# EasyEDA Pro project Iot-Whgm5开发板.eprj, board PCB1 (continued)
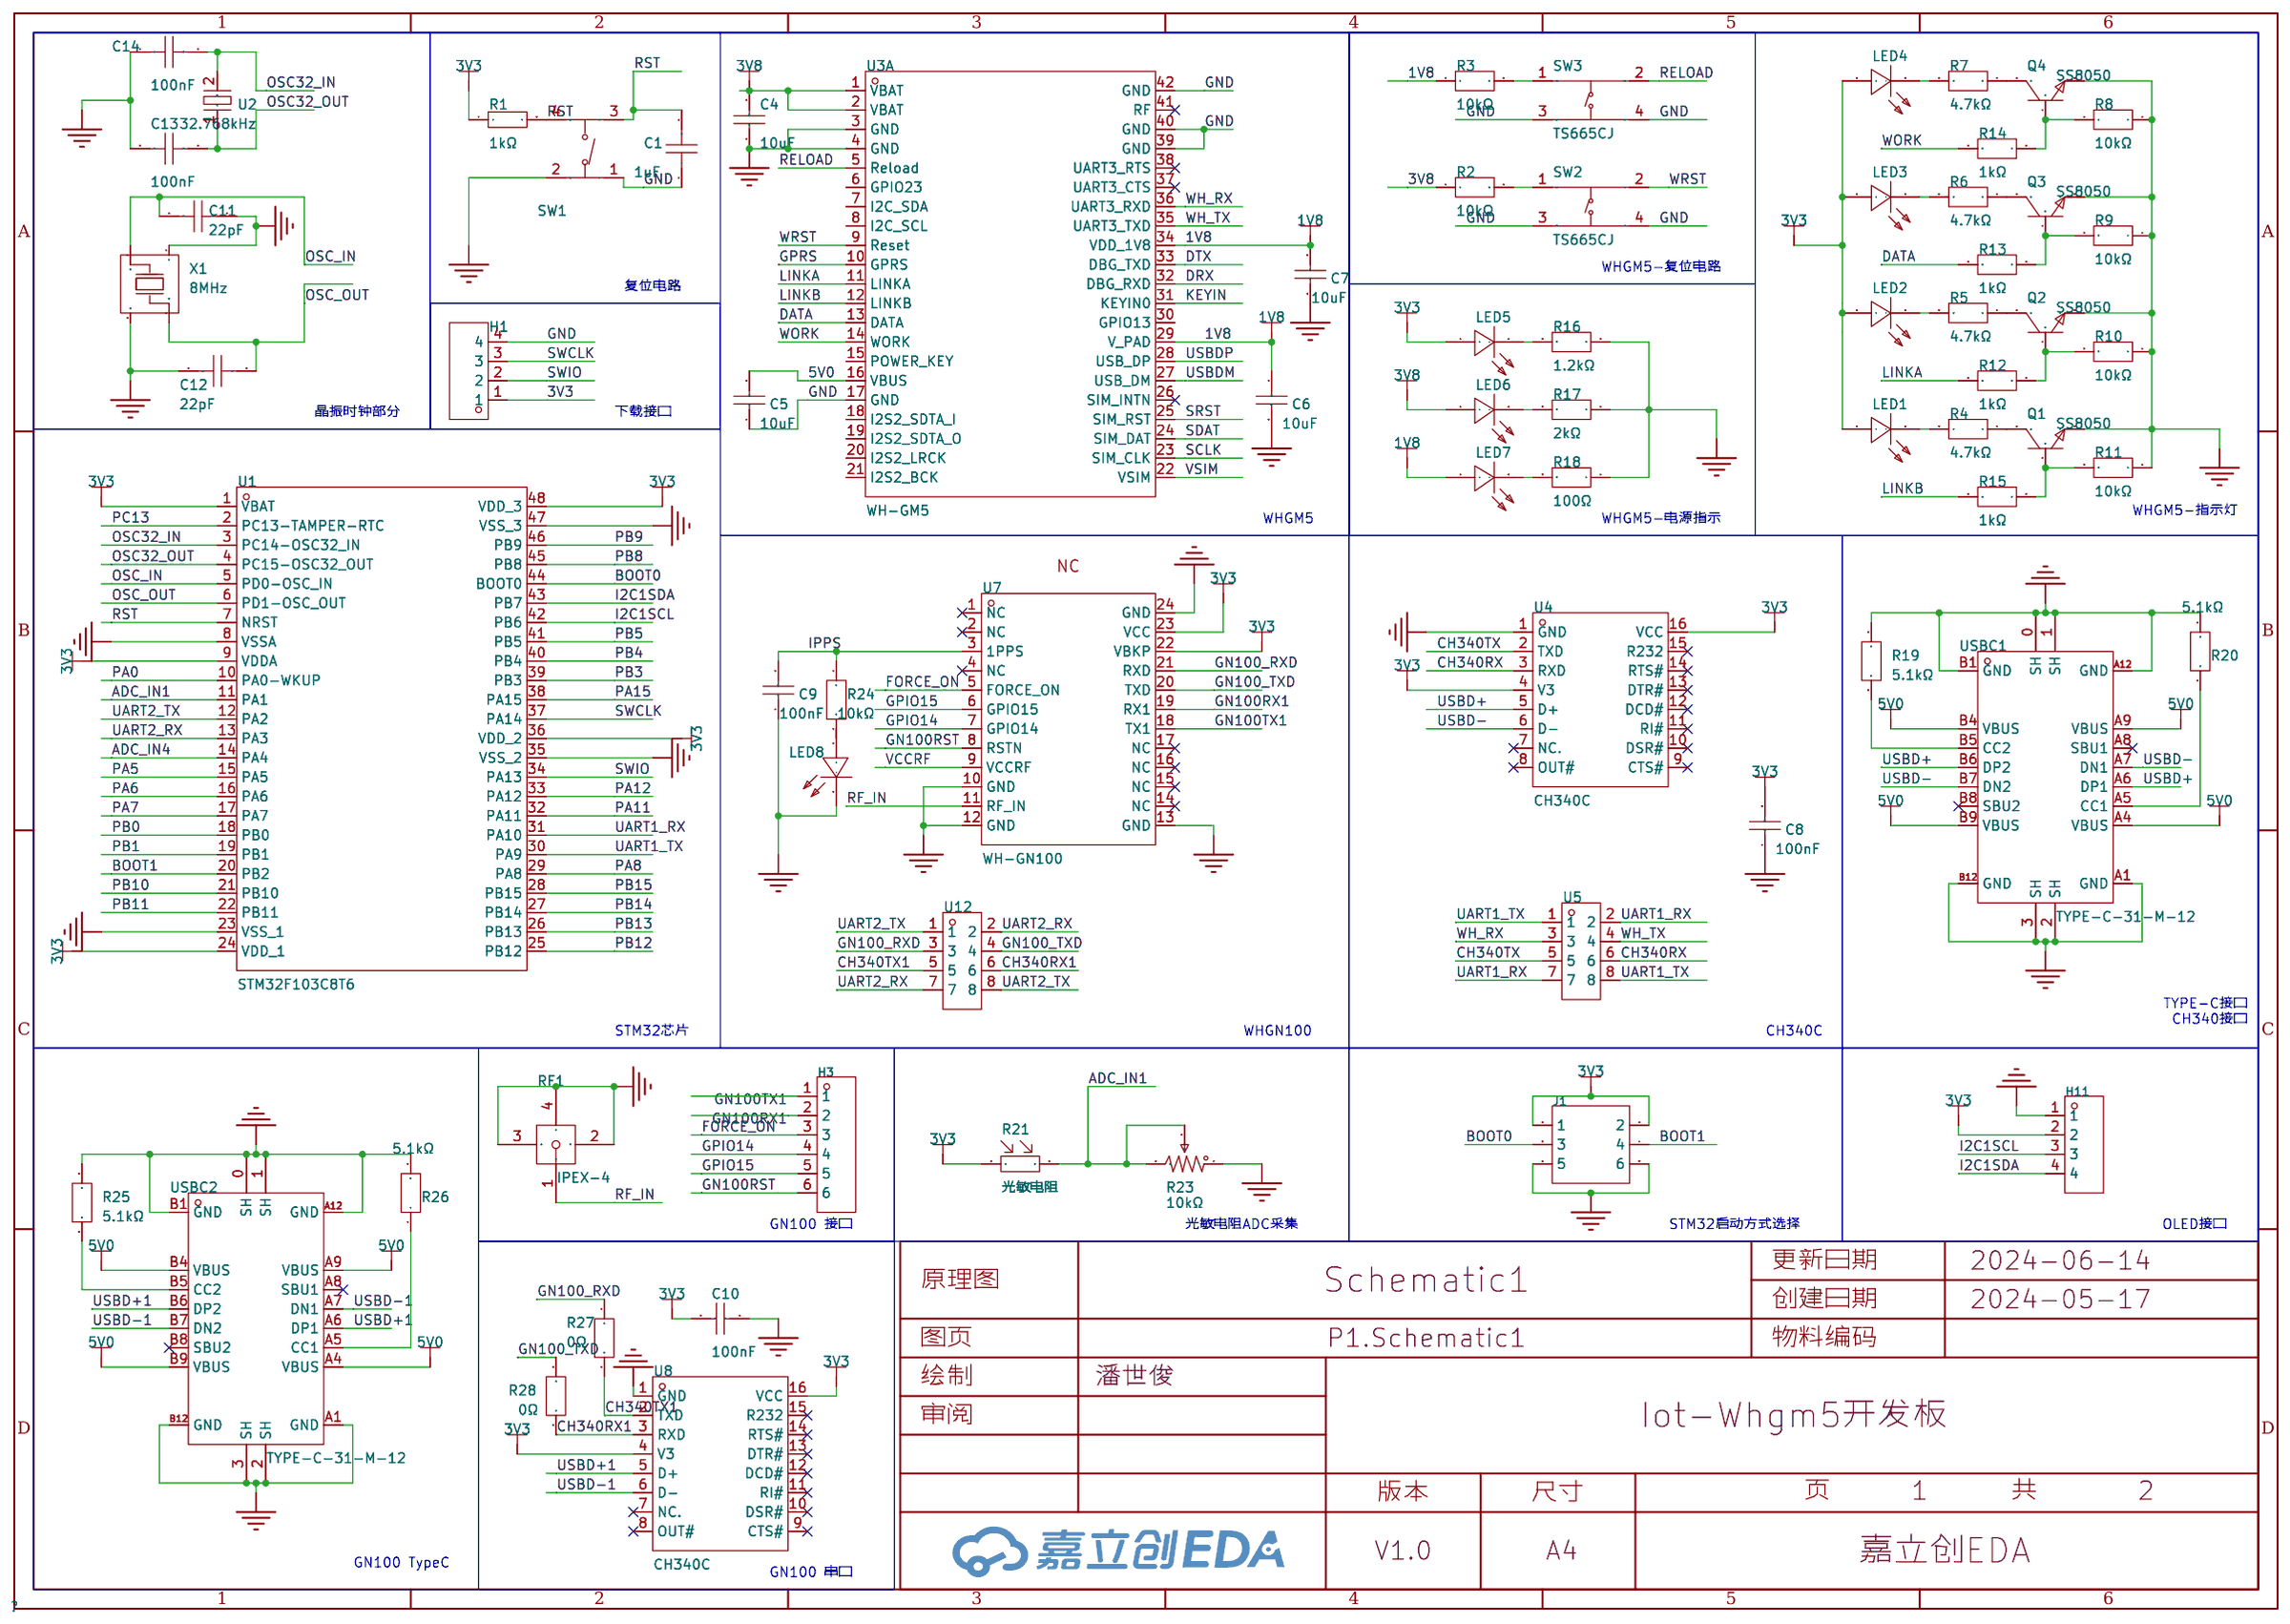
[diagram p0: P1]
## Routing (per net, layer and track width the routed paths; a pad name or vN(x,y) marks a point on that pad's centre or on a via; arc(x,y) is an arc through that point)
1V8: length 50.3
  Top Layer w0.254: U3.29 46.01,46.24 C7.1 47.2,38.87 40.13,31.8 31.24,31.8 C20.1 ; U3.34 49.87,52.59 LED7.1 ; v1(49.92,52.56) 49.92,55.58 R3.1
  Bottom Layer w0.254: v1(49.92,52.56) 49.92,51.46 C6.1 47.2,48.75 v1(47.2,47.37)
3V3: length 17.5
  Top Layer w0.178: 48.82,26.18 49.41,25.58 v1(50.8,25.58)
  Top Layer w0.254: 51.64,29 51.64,29.3 v1(51.95,29.6) ; 61.27,28.31 61.27,28.3 v1(60.38,27.41) ; 57.65,22.99 57.97,22.67 v1(58.55,22.67) ; v1(52.32,18.97) 52.19,19.1 51.64,19.1 ; v1(53.59,29.64) 53.77,29.47 53.77,29
  Top Layer w0.508: 5.4,49.66 5.4,47.35 5.42,47.33 5.42,45.12 5.88,44.66 v1(5.88,41.49) ; 5.39,52.03 5.39,49.56
  vias: v1(2.05,29.84) v1(4.7,31.95) v1(8.52,25.07) v1(27.77,4.58) v1(29.29,10.04) v1(30.63,4.63) v1(35.18,21.77) v1(36.83,19.99) v1(46.92,16.05) v1(51.93,14.27) v1(57.81,33.97) v1(64.39,22.91) v1(70.87,49.83) v1(70.87,48.77) v1(71.25,26.72) v1(73.41,50.34) v1(73.53,45.03) v2(45.59,8.18) v2(48.13,5.64) v2(50.67,3.35) v2(55.43,2.39)
3V8: length 48.4
  Top Layer w0.254: U3.2 18.88,61.48 17.78,60.38 17.78,59.74 v1(14.48,56.44) ; C4.2 17.53,27.98 v1(17.53,45.39)
  Top Layer w0.508: U3.2 U3.1 17.9,64.23 R2.1 15.24,65.83 15.24,68.12 16.03,68.91 LED6.1
  Bottom Layer w0.254: v1(17.53,45.39) 17.53,50.85 14.48,53.9 v1(14.48,56.44)
5V0: length 167.8
  Top Layer w0.254: USBC3.B9 6.78,62.5 6.56,62.28 5.59,62.28 4.44,63.42 3.68,63.42 3.56,63.3 3.56,57.33 3.81,57.07 4.34,57.07 5.46,58.19 6.63,58.19 7.12,57.7 USBC3.A9 7.69,57.84 v1(8.76,57.84) ; v1(21.97,44.23) 21.97,21.43 AMS1117-ADJ.3 ; USBC2.A9 USBC2.B4 72.23,7.08 72.08,6.94 72.08,6.93 72.01,6.86 72.01,5.64 72.52,5.13 72.52,2.08 72.26,1.83 67.56,1.83 67.31,2.08 67.31,5 67.94,5.64 67.94,6.86 67.73,7.08 USBC2.B9 67.73,8.5 67.29,8.94 65.41,8.94 60.45,3.99 47.24,3.99 32.24,18.99 AMS1117-1V8.3
  Top Layer w0.381: U3.16 21.44,43.7 v1(21.97,44.23) ; USBC1.B9 7.72,17.07 9.02,17.07 v1(9.4,17.45) ; DC1.1 13.08,14.1 v1(11.54,15.64) ; v1(8.76,12.37) 7.82,12.37 USBC1.A9
  Top Layer w0.508: AMS1117-3V3.3 22.49,2.32 19.81,5 19.81,14.38 C16.1
  Bottom Layer w0.254: v1(8.76,57.84) 15.75,57.84 21.97,51.61 v1(21.97,44.23)
  Bottom Layer w0.381: v1(9.4,17.45) 11.21,15.64 v1(11.54,15.64) 11.56,15.62 11.56,13.64 10.78,12.87 9.26,12.87 v1(8.76,12.37)
GND: length 2.6
  Top Layer w0.178: STM32F103C8T6.8 48.72,27.1 v2(48.13,27.1)
  Top Layer w0.254: v1(58.17,21.89) 58.05,21.89 57.3,22.64
  vias: v2(6.1,27.48) v2(6.98,33.83) v2(15.88,62.66) v2(16.76,35.1) v2(19.38,42.43) v2(24,20.75) v2(24,11.48) v2(31.37,43.48) v2(31.37,33.07) v2(32.13,49.71) v2(37.72,49.58) v2(37.97,43.61) v2(38.35,11.35) v2(39.24,39.55) v2(40.64,6.91) v2(45.09,21.39) v2(45.85,40.69) v2(46.99,25.07) v2(48.26,16.69) v2(48.39,8.94) v2(50.71,5.71) v2(51.69,23.42) v2(52.45,26.09) v2(53.25,3.25) v2(53.47,17.45) v2(57.53,2.52) v2(58.04,17.45) v2(59.69,19.86) v2(59.94,23.55) v2(60.2,21.13) v2(60.71,7.92) v2(61.59,32.05) v2(62.48,3.35) v2(63.75,12.88) v2(64.01,17.07) v2(67.77,20.76) v2(69.98,3.86) v2(70.23,14.91) v2(73.66,19.35) v2(73.79,21.51) v2(76.45,42.72) v2(78.61,22.53) v2(83.06,46.79)
VCCRF: length 9.6
  Top Layer w0.178: v1(62.74,38.28) 60.72,40.29 U7.9
  Bottom Layer w0.178: v1(62.48,34.34) 62.74,34.59 v1(62.74,38.28)
ADC_IN1: length 103.5
  Top Layer w0.178: H5.2 82.68,4.35 82.68,2.21 80.86,0.39 52.34,0.39 52.32,0.41 52.08,0.41 49.79,2.69 44.09,2.69 v1(35.18,11.61)
  Top Layer w0.254: v1(46.35,26.47) 46.79,26.03 47.54,26.03 49.01,24.56 v1(52.58,24.56)
  Top Layer w0.508: 贴片可调电阻 10M.3 66.41,31.8 贴片可调电阻 10M.2 63.08,30.72 光敏电阻.2
  Bottom Layer w0.178: v1(35.18,11.61) 35.18,13.88 41.56,20.26 41.56,22.67 44.22,25.33 44.22,26.24 44.7,26.72 46.1,26.72 v1(46.35,26.47)
  Bottom Layer w0.254: v1(52.58,24.56) 53.03,25.01 53.03,26.06 57.68,30.72 光敏电阻.2
ADC_IN4: length 52.6
  Top Layer w0.178: 热敏电阻.2 45.32,14.64 v1(44.32,13.64) ; H5.5 81.13,13.51 78.09,13.51 78.09,13.52 77.6,14.02 76.96,14.02 76.45,13.51 75.06,13.51 73.15,11.61 v1(70.36,11.61) ; v1(44.32,11.1) 49.02,6.4 51.82,6.4 54.98,9.56 v1(54.98,11.59)
  Top Layer w0.254: 48.11,22.64 44.91,19.44 10M可变电阻.2
  Bottom Layer w0.178: v1(70.36,11.61) 55.12,11.61 ; v1(44.32,11.1) v1(44.32,13.64)
BOOT0: length 19.4
  Top Layer w0.178: v1(52.71,27.1) 54.69,27.1 55.18,27.59
  Bottom Layer w0.178: J1.3 40,23.16 40,25.07 42.16,27.23 44.18,27.23 44.84,27.89 46.72,27.89 46.73,27.86 48.26,27.86 49.78,26.34 51.94,26.34 v1(52.71,27.1)
BOOT1: length 16.9
  Top Layer w0.178: v1(47.5,17.7) 50.23,20.44 50.23,20.52
  Top Layer w0.254: 38.22,24.95 39.87,24.95 40.51,24.31 40.77,24.31 v1(42.42,22.66)
  Bottom Layer w0.254: v1(42.42,22.66) 42.42,21.51 46.23,17.7 v1(47.5,17.7)
CH340RX: length 22.8
  Top Layer w0.254: CH340C.3 7.24,27.45 4.06,30.63 4.06,33.95 4.06,33.95 5.32,35.22 15.11,35.22 U5.6
  vias: v1(7.25,25.07)
CH340RX1:
  vias: v1(65.53,24.18)
CH340TX: length 22.7
  Top Layer w0.254: U5.5 12.74,36.36 12,35.62 4.46,35.62 3.17,34.34 3.17,28.37 3.56,27.99 3.68,27.99 4.32,28.63 4.57,28.63 4.88,28.31 4.88,27.17 5.59,26.47 5.59,26.01 5.97,25.63
  vias: v1(5.97,25.07)
CH340TX1:
  vias: v1(65.53,25.45)
DATA: length 5.1
  Top Layer w0.254: R13.2 14.7,47.51 U3.13
FORCE_ON: length 14
  Top Layer w0.254: U7.5 62.16,46.59 65.79,50.22 65.79,54.86 H3.3
GN100_RXD: length 47.9
  Top Layer w0.254: v1(72.64,48.82) 72.64,48.48 72.55,48.39 72.26,48.39 71.93,48.06 71.93,47.45 71.88,47.4 71.76,47.4 71.46,47.69 70.24,47.69 ; v1(73.49,13.02) 72.7,13.81 72.7,22.66 73.15,23.11 v1(73.15,23.55)
  Bottom Layer w0.254: v1(72.64,48.82) 72.64,48.48 72.73,48.39 73.27,48.39 74.29,47.37 74.29,46.91 73.75,46.37 72.94,46.37 72.85,46.28 72.85,24.28 73.15,23.98 v1(73.15,23.55) ; v1(73.49,13.02) 73.85,13.39 76.45,13.39 77.72,12.12 U12.3
GN100_TXD: length 46.3
  Top Layer w0.254: v1(71.5,13.02) 72.29,13.81 72.29,23.39 v1(72.14,23.55) ; 70.24,46.59 70.63,46.99 72.05,46.99 72.34,47.28 72.34,47.89 72.43,47.98 72.55,47.98 72.64,47.89 v1(72.64,47.55)
  Bottom Layer w0.254: v1(72.14,23.55) 72.14,23.98 72.44,24.28 72.44,46.45 72.77,46.77 73.58,46.77 73.88,47.07 73.88,47.2 73.1,47.98 72.73,47.98 72.64,47.89 v1(72.64,47.55) ; U12.4 72.41,12.12 v1(71.5,13.02)
GN100RST: length 17.4
  Top Layer w0.254: H3.6 59.88,53.25 v1(59.88,48.92) ; v1(61.98,45.9) 61.98,45.33 U7.8
  Bottom Layer w0.254: v1(59.88,48.92) 59.91,48.95 60.96,48.95 61.98,47.93 v1(61.98,45.9)
GN100RX1: length 22.9
  Top Layer w0.254: H3.2 69.35,54.91 69.44,55 69.44,56.64 67.65,58.43 67.53,58.43 67.44,58.34 67.44,57.69 67.69,57.44 67.94,57.44 68.2,57.18 68.2,56.17 67.94,55.91 67.69,55.91 67.44,55.66 67.44,51.83 67.69,51.58 67.86,51.58 68.11,51.32 68.11,50.31 67.86,50.05 67.69,50.05 67.44,49.8 67.44,48.53 67.7,48.27 67.7,47.01 67.44,46.75 67.44,46.24 68.53,45.15 68.66,45.15 69.01,45.49 70.24,45.49
GN100TX1: length 23
  Top Layer w0.254: H3.1 69.94,54.91 69.85,55 69.85,56.81 67.82,58.84 67.36,58.84 67.03,58.51 67.03,46.07 68.37,44.74 68.66,44.74 69.01,44.39 70.24,44.39
GPIO14: length 12.8
  Top Layer w0.254: v1(61.09,47.68) 63.3,49.89 H3.4
  Bottom Layer w0.254: v1(61.09,47.68) 61.09,45.9 59.69,44.5 v1(58.8,44.5)
GPIO15: length 10.6
  Top Layer w0.254: v1(59.82,47.68) 60.76,48.62 H3.5
  Bottom Layer w0.254: v1(58.67,45.52) 59.31,45.52 59.82,46.02 v1(59.82,47.68)
I2C1SCL: length 56.5
  Top Layer w0.254: v1(40.89,31.55) 40.89,29.01 45.94,23.96 v1(47.68,23.96) 52.96,23.96 58.14,29.13 59.69,29.13 59.94,29.39 68.83,29.39 72.64,33.2 H8.6 ; v1(39.75,32.82) 37.34,35.23 31.41,35.23 GND.3
  Bottom Layer w0.254: v1(40.89,31.55) 40.89,31.67 v1(39.75,32.82)
I2C1SDA: length 56.8
  Top Layer w0.254: v1(51.56,26.97) 51.56,25.83 51.94,25.45 53.72,25.45 55.51,27.24 55.53,27.24 57.94,29.64 59.56,29.64 59.82,29.9 68.71,29.9 73.79,34.98 75.18,34.98 H8.7 ; v1(38.48,32.44) 29.04,32.44 GND.4
  Bottom Layer w0.254: v1(51.56,26.97) 50.29,28.24 42.67,28.24 v1(38.48,32.44)
IPPS: length 1.8
  Bottom Layer w0.254: C9.2 56.9,50.12 v1(56.9,48.57)
LINKA: length 5.6
  Top Layer w0.254: U3.11 15.95,50.05 R12.2
LINKB: length 5.2
  Top Layer w0.254: R15.2 18.84,49.33 U3.12
OSC32_IN: length 9.4
  Top Layer w0.254: 50.94,28.3 50.04,29.2 50.04,31.67 52.28,33.91 52.67,33.91 100NF#2.2
OSC32_OUT: length 8.7
  Top Layer w0.254: 50.58,27.94 49.89,28.64 49.89,28.84 49.68,29.05 49.68,31.82 50.12,32.26 32K晶振.1 100NF.1
OSC_IN: length 8.3
  Top Layer w0.254: 22PF.2 47.58,34.02 8MHZ晶振.1 48.83,32.04 49.33,31.55 49.33,28.9 49.4,28.83 49.4,28.42 50.23,27.59
OSC_OUT: length 8.4
  Top Layer w0.254: 22PF#2.2 45.24,30.15 8MHZ晶振.3 46.28,29.39 48.35,29.39 49.02,28.72 49.02,28.09 49.88,27.24
PA0: length 75.1
  Top Layer w0.178: H5.1 79.01,0.69 52.2,0.69 49.91,2.97 45.34,2.97 35.18,13.13 v1(35.18,14.66)
  Top Layer w0.254: v1(47.24,26.97) 47.31,26.97 48.46,25.82
  Bottom Layer w0.178: v1(47.24,26.97) 46.61,27.61 44.96,27.61 43.94,26.59 43.94,25.47 41.28,22.8 41.28,20.75 v1(35.18,14.66)
PA5: length 48.3
  Top Layer w0.178: v1(46.1,19.74) 46.1,20.12 47.61,21.63 47.8,21.63 48.46,22.29
  Bottom Layer w0.178: v1(46.1,19.74) 46.1,19.1 46.35,18.85 47.88,18.85 50.34,16.38 50.34,14.1 53.77,10.67 79.32,10.67 80.01,11.35 80.01,14.38 H5.6
PA6: length 48.8
  Top Layer w0.178: v1(47.62,20.75) 47.64,20.75 48.82,21.93
  Bottom Layer w0.178: H5.7 81.41,17.58 79.73,15.9 79.73,11.58 79.12,10.97 53.97,10.97 50.67,14.27 50.67,16.56 48.01,19.23 46.99,19.23 46.86,19.35 46.86,19.99 v1(47.62,20.75)
PA7: length 43.5
  Top Layer w0.178: 49.17,21.58 48.39,20.8 48.39,20.55 47.75,19.91 v1(47.75,19.86)
  Bottom Layer w0.178: v1(47.75,19.86) 47.88,19.86 52.58,15.16 64.01,15.16 65.34,13.83 68.77,13.83 68.83,13.89 68.83,13.89 69.22,14.27 70.46,14.27 70.52,14.21 ; 70.52,14.21 74.36,14.21 74.55,14.4 74.55,17.96 74.93,18.34 76.33,18.34 78.85,20.86 H5.8 ; 70.52,14.21 70.53,14.22
PA8: length 85
  Top Layer w0.178: v1(67.69,10.08) 68.33,10.72 68.33,12.88 66.17,15.04 65.02,15.04 64.26,15.8 61.21,15.8 v1(60.58,16.43) ; v1(82.55,7.04) 84.07,8.56 v1(84.07,9.45) ; 55.18,20.52 54.72,20.98 54.72,23.53 55.63,24.43 56.01,24.43 56.19,24.26 58.12,24.26 59.31,23.06 v1(59.31,21.26)
  Bottom Layer w0.178: v1(60.58,16.43) 60.58,16.79 60.4,16.97 59.96,16.97 59.78,17.14 59.78,18.31 59.96,18.49 60.4,18.49 60.58,18.67 60.58,19.86 59.31,21.13 v1(59.31,21.26) ; v1(82.55,7.04) 82.04,7.04 81.91,6.91 81.03,6.91 80.14,6.02 77.37,6.02 75.46,7.92 75.46,8.04 73.78,9.73 70.2,9.73 69.59,10.34 68.58,10.34 68.33,10.08 v1(67.69,10.08) ; v1(84.07,9.45) 84.07,41.05 H5.17
PA11: length 92.5
  Top Layer w0.178: v1(79.38,20.24) 79.38,25.96 v1(80.52,27.1) ; v1(77.34,13.39) 77.22,13.26 77.22,11.48 76.58,10.85 75.18,10.85 74.42,10.08 74.42,8.81 75.31,7.92 75.31,5.89 v1(74.93,5.51) ; v1(79.88,17.7) 79.88,17.96 v1(78.87,18.97) ; 56.24,21.58 59.56,18.26 59.56,15.16 64.64,10.08 v1(65.91,10.08)
  Bottom Layer w0.178: H5.20 80.25,51.34 79.38,50.47 79.38,28.24 v1(80.52,27.1) ; v1(79.38,20.24) 78.87,19.74 v1(78.87,18.97) ; v1(65.91,10.08) 64.13,8.31 64.13,1.96 64.77,1.32 72.64,1.32 73.15,1.83 73.15,3.73 v1(74.93,5.51) ; v1(77.34,13.39) 77.34,15.29 77.98,15.93 79.25,15.93 80.14,16.81 80.14,17.45 v1(79.88,17.7)
PA12: length 22.9
  Top Layer w0.178: v1(67.94,17.45) 65.66,19.74 64.01,19.74 63.5,19.23 59.3,19.23 56.59,21.93
  Bottom Layer w0.178: v1(67.94,17.45) 68.71,17.45 71.75,20.5 H8.1
PA15: length 20.6
  Top Layer w0.254: 57.3,25.47 57.92,26.09 59.18,26.09 60.96,24.31 63.5,24.31 64.01,24.82 74.17,24.82 H8.2
PB0: length 70.5
  Top Layer w0.178: v1(68.45,9.45) 64.77,9.45 58.42,15.8 v1(57.28,15.8) ; v1(48.64,19.99) 48.77,20.12 48.77,20.47 49.52,21.23
  Bottom Layer w0.178: v1(48.64,19.99) 48.64,19.61 52.45,15.8 v1(57.28,15.8) ; v1(68.45,9.45) 73.66,9.45 75.18,7.92 75.18,7.63 76.33,6.49 76.33,1.51 76.64,1.19 83.01,1.19 83.19,1.37 83.19,18.37 83.51,18.7 83.51,21.51 81.63,23.4 H5.9
PB1: length 37.2
  Top Layer w0.178: v1(71.75,27.36) 73.15,27.36 v1(73.53,26.97) ; v1(51.31,22.28) 49.9,20.87 49.88,20.87
  Bottom Layer w0.178: v1(51.31,22.28) 51.94,22.28 55.75,26.09 60.45,26.09 62.05,24.49 63.42,24.49 64.26,25.32 64.26,26.72 65.15,27.61 71.5,27.61 v1(71.75,27.36) ; H5.10 80.42,25.94 79.64,26.72 73.79,26.72 v1(73.53,26.97)
PB3: length 21.6
  Top Layer w0.254: v1(64.26,27.61) 64.64,27.99 73.53,27.99 H8.3 ; 56.95,25.82 57.85,26.72 v1(58.04,26.72)
  Bottom Layer w0.254: 58.28,26.72 v1(58.04,26.72) 58.55,27.23 59.31,27.23 59.82,26.72 63.37,26.72 v1(64.26,27.61)
PB4: length 21.3
  Top Layer w0.254: H8.4 75.67,28.4 63.39,28.4 61.36,26.36 59.92,26.36 58.81,27.48 57.9,27.48 56.59,26.18
PB5: length 22.5
  Top Layer w0.254: H8.5 74.04,28.75 63.25,28.75 61.21,26.72 60.07,26.72 58.8,27.99 57.66,27.99 56.24,26.57 56.24,26.53
PB8: length 25.5
  Top Layer w0.254: 54.83,27.94 55.52,28.64 55.52,28.84 61.78,35.1 71.12,35.1 73.53,37.52 75.18,37.52 H8.8
PB9: length 27.8
  Top Layer w0.254: H8.9 74.29,40.82 73.03,39.55 73.03,37.64 70.87,35.48 61.66,35.48 54.47,28.3
PB10: length 38.8
  Top Layer w0.178: H5.11 81.01,28.48 76.96,24.43 75.18,24.43 v1(73.53,26.09) v1(71.75,26.09) ; 50.58,20.16 51.82,21.4 v1(51.82,21.64)
  Bottom Layer w0.178: v1(71.75,26.09) 69.85,26.09 68.71,27.23 65.28,27.23 64.64,26.59 64.64,25.2 63.63,24.18 61.85,24.18 60.32,25.7 55.88,25.7 v1(51.82,21.64)
PB11: length 44.3
  Top Layer w0.178: v1(52.32,21.01) 52.13,21.01 50.94,19.81 ; v1(61.21,23.29) 61.21,22.78 62.1,21.89 63.01,21.89 63.39,22.28 v1(68.07,22.28)
  Bottom Layer w0.178: v1(68.07,22.28) 73.15,22.28 75.06,24.18 79.25,24.18 79.76,24.69 82.17,24.69 82.8,25.32 82.8,29.62 H5.12 ; v1(52.32,21.01) 52.45,21.13 52.45,21.64 56.01,25.2 60.2,25.2 61.21,24.18 v1(61.21,23.29)
PB12: length 96.8
  Top Layer w0.178: v1(42.42,13.13) 42.74,12.81 46.16,12.81 47.37,14.02 47.37,14.66 50.93,18.21 52.45,18.21 52.96,18.72 52.96,18.97 53.09,19.1 53.09,19.1 53.77,19.1
  Bottom Layer w0.178: v1(42.42,13.13) 43.69,11.86 43.69,8.45 50.44,1.7 59.98,1.7 61.14,0.53 75.54,0.53 75.77,0.76 83.28,0.76 83.53,1.01 83.53,18.3 83.79,18.57 83.79,23.42 83.53,23.69 83.53,31.44 H5.13
PB13: length 89.7
  Top Layer w0.178: H5.14 84.71,32.8 84.71,7.54 83.44,6.27 82.42,6.27 81.93,6.76 80.88,6.76 80.14,6.02 80.14,2.46 78.99,1.32 v1(75.69,1.32) ; v1(48.01,14.4) 50.04,16.43 55.5,16.43 55.75,16.69 55.75,17.82 54.12,19.46
  Bottom Layer w0.178: v1(48.01,14.4) 61.59,0.81 74.68,0.81 75.18,1.32 v1(75.69,1.32)
PB14: length 67.6
  Top Layer w0.178: H5.15 80.01,37.24 80.01,30.66 81.03,29.64 82.42,29.64 82.8,29.26 v1(82.8,21.13) ; v1(65.91,14.4) 65.91,14.27 v1(67.56,12.62) ; v1(53.09,21.39) 53.09,21.2 54.47,19.81
  Bottom Layer w0.178: v1(67.56,12.62) 69.09,12.62 70.36,13.89 74.68,13.89 74.8,14.02 74.8,14.28 74.83,14.29 74.83,15.54 75.34,16.05 76.58,16.05 77.22,16.69 77.22,17.93 77.78,18.49 77.93,18.34 78.99,18.34 79.12,18.21 79.2,18.21 80.54,19.56 81.86,19.56 82.55,20.24 82.55,20.88 v1(82.8,21.13) ; v1(65.91,14.4) 65.91,16.69 63.88,18.72 63.88,21.26 63.5,21.64 61.98,21.64 60.65,22.97 60.65,23.6 59.44,24.82 56.13,24.82 53.09,21.77 v1(53.09,21.39)
PB15: length 116.1
  Top Layer w0.178: v1(50.55,22.78) 50.58,22.82 52.54,22.82 53.71,21.66 53.71,21.28 54.83,20.16 ; v1(79.76,7.8) 79.76,2.84 79.12,2.21 75.56,2.21 74.42,1.07 52.4,1.07 50.21,3.25 46.08,3.25 42.42,6.91 v1(42.42,7.04) ; v1(82.93,19.74) 83.44,20.24 v1(83.44,33.07) ; v1(43.81,21.77) 39.24,17.2 v1(39.24,16.05)
  Bottom Layer w0.178: v1(82.93,19.74) 82.68,19.48 82.68,9.96 82.17,9.45 80.9,9.45 79.76,8.31 v1(79.76,7.8) ; v1(43.81,21.77) 45.47,23.42 45.47,25.2 45.85,25.58 47.75,25.58 v1(50.55,22.78) ; v1(42.42,7.04) 39.24,10.21 v1(39.24,16.05) ; H5.16 83.44,39.15 v1(83.44,33.07)
PC13: length 5.8
  Top Layer w0.254: 51.29,28.65 50.67,29.27 v1(50.67,29.77)
  Bottom Layer w0.254: v1(50.67,29.77) 51.75,30.84 R46.2
RELOAD: length 31
  Top Layer w0.254: U3.5 20.36,57.67 21.59,56.44 v1(41.66,56.44)
  Bottom Layer w0.254: v1(41.66,56.44) 47.63,56.44 SW3.2
RF_IN: length 8.2
  Top Layer w0.343: U7.11 55.81,38.09 52.07,41.83 52.07,42.49 RF1.1
RST: length 37.5
  Top Layer w0.254: RST.4 50.52,9.47 R1.2 51.26,12.12 52.58,12.12 53.71,13.25 RST.3 57.6,13.25 C1.2 ; v1(44.96,26.09) 46.61,27.74 48.67,27.74 49.52,26.88
  Bottom Layer w0.254: v1(50.47,12.8) 49.91,13.35 49.91,16.31 47.75,18.47 45.97,18.47 42.8,21.64 42.8,22.15 44.96,24.31 v1(44.96,26.09)
SCLK: length 29.3
  Top Layer w0.254: v1(34.42,53.52) 34.35,53.45 34.35,39.74 35.47,38.62 U3.23
  Bottom Layer w0.254: v1(34.42,53.52) 34.42,54.95 31.53,57.83
SDAT: length 39
  Top Layer w0.254: v1(35.05,54.66) 35.05,43.74 36.19,42.6 40.26,42.6 41.91,40.94 41.91,40.44 42.42,39.93 43.84,39.93 U3.24
  Bottom Layer w0.254: 31.53,70.54 35.05,67.02 v1(35.05,54.66)
SRST: length 31.6
  Top Layer w0.254: U3.25 42.55,41.16 40.51,43.2 40.51,55.17 40.13,55.55 29.46,55.55 v1(28.7,54.79)
  Bottom Layer w0.254: CARD1.2 28.99,55.08 v1(28.7,54.79)
SWCLK: length 6.2
  Top Layer w0.254: H1.3 61.72,23.93 60.83,23.93 59.18,25.58 58.12,25.58 57.65,25.11
SWIO: length 6.4
  Top Layer w0.254: H1.2 58.74,20.5 56.95,22.29
UART1_RX: length 150.3
  Top Layer w0.178: U5.2 15,40.18 13.33,40.18 v1(10.67,37.52) ; v1(10.67,33.83) 10.67,33.07 10.85,32.89 14.86,32.89 15.06,33.1 15.06,34.01 14.48,34.59 13.89,34.59 13.72,34.42 U5.7 ; H5.19 83.71,48.8 84.46,48.06 84.46,46.28 83.19,45.01 80.77,45.01 77.85,42.09 v1(71.63,42.09)
  Top Layer w0.254: v1(31.75,30.78) 31.75,30.35 31.94,30.16 31.94,29.86 33,28.81 33,20.71 41.62,12.09 47.16,12.09 50.71,15.65 55.92,15.65 56.59,16.31 56.59,20.46 56.38,20.67 56.38,20.73 55.89,21.23
  Bottom Layer w0.178: v1(71.63,42.09) 68.71,42.09 66.42,39.8 49.4,39.8 48.77,39.17 48.77,38.4 45.72,35.36 40.51,35.36 35.18,30.02 32.51,30.02 v1(31.75,30.78)
  Bottom Layer w0.254: U5.7 14.78,32.75 14.78,32.46 15.33,31.92 31.64,31.92 31.75,31.8 v1(31.75,30.78) ; v1(10.67,37.52) 10.14,37.52 10.05,37.43 10.05,34.46 v1(10.67,33.83)
UART1_TX: length 148.9
  Top Layer w0.178: U5.8 15,32.56 9.91,32.56 9.02,33.45 v1(9.02,33.83) ; U5.1 13.72,41.03 11.6,38.91 10.35,38.91 10.23,39.04 9.91,39.04 8.83,37.96 8.83,37.71 v1(9.02,37.52) ; v1(71.63,43.36) 77.6,43.36 79.5,45.26 79.5,46.66 80.39,47.55 82.01,47.55 82.65,48.18 83.06,48.18 83.88,47.36 83.88,46.34 82.93,45.39 82.3,45.39 81.43,46.26 H5.18
  Top Layer w0.254: v1(32.54,31.07) 32.54,30.35 32.35,30.16 32.35,30.03 33.4,28.98 33.4,20.88 41.78,12.5 46.99,12.5 50.55,16.05 55.75,16.05 56.18,16.48 56.18,20.29 56.09,20.38 56.03,20.38 55.53,20.87
  Bottom Layer w0.178: v1(71.63,43.36) 71.44,43.55 71.19,43.55 70.69,43.05 70.69,42.62 70.49,42.42 68.57,42.42 66.28,40.13 49.27,40.13 48.44,39.3 48.44,38.54 45.58,35.69 40.38,35.69 35.04,30.35 33.26,30.35 v1(32.54,31.07)
  Bottom Layer w0.254: v1(32.54,31.07) 32.54,31.8 32.02,32.32 15.49,32.32 15.19,32.63 15.19,32.75 U5.8 ; v1(9.02,37.52) 9.55,37.52 9.64,37.43 9.64,34.46 v1(9.02,33.83)
UART2_RX: length 69.8
  Top Layer w0.178: v1(73.79,16.43) 74.38,17.03 74.47,17.03 75.71,15.8 76.97,15.8 77.41,16.23 77.41,17.13 77.47,17.2 U12.7 ; v1(46.23,22.91) 46.23,23.64 46.23,23.64 47.11,23.64 47.76,22.99 ; v1(65.15,15.8) 65.54,15.8 65.89,16.14 65.98,16.14 66.45,15.67 68.14,15.67 68.2,15.61 68.2,15.42 v1(67.94,15.16)
  Top Layer w0.254: U12.7 79.12,17.2 79.38,16.94 79.5,17.07 83.57,17.07 83.66,16.98 83.66,10.69 82.6,9.63 82.47,9.63 H5.4 81.26,10.85 77.24,10.85 U12.2
  Bottom Layer w0.178: v1(65.15,15.8) 65.15,15.98 65.02,16.1 61.84,16.1 60.96,16.98 60.96,21.18 58.67,23.47 57.16,23.47 53.35,19.66 52.27,19.66 49.13,22.8 48.87,22.8 47.7,21.63 46.71,21.63 46.46,21.89 46.46,22.29 46.23,22.52 v1(46.23,22.91) ; v1(67.94,15.16) 68.96,16.18 69.12,16.18 69.81,16.87 73.72,16.87 73.79,16.8 v1(73.79,16.43)
UART2_TX: length 74.2
  Top Layer w0.178: 47.76,25.11 46.91,24.27 46.23,24.27 v1(46.23,24.82) ; v1(73.66,17.96) 74.26,17.36 74.61,17.36 75.84,16.13 76.84,16.13 77.08,16.37 77.08,17.13 77.01,17.2 U12.8 ; v1(68.45,16.56) 68.45,16.26 68.2,16 66.58,16 66.11,16.47 65.89,16.47 65.54,16.81 v1(64.9,16.81)
  Top Layer w0.254: U12.1 79.99,9.58 H5.3 82.47,9.23 82.77,9.23 84.06,10.52 84.06,17.15 83.73,17.47 83.16,17.47 82.8,17.83 82.8,18.89 82.09,19.61 78.38,19.61 U12.8
  Bottom Layer w0.178: v1(73.66,17.96) 73.72,17.89 73.72,17.26 73.66,17.2 69.67,17.2 69.04,16.56 v1(68.45,16.56) ; v1(64.9,16.81) 65.02,16.69 65.02,16.5 64.96,16.43 61.98,16.43 61.29,17.12 61.29,21.32 58.81,23.8 57.02,23.8 53.21,19.99 52.41,19.99 49.26,23.13 48.74,23.13 47.56,21.96 46.85,21.96 46.79,22.02 46.79,24.26 v1(46.23,24.82)
USBD+: length 18.1
  Top Layer w0.254: USBC1.B6 7.67,14.02 6.86,14.02 6.73,13.89 6.73,13.77 6.1,13.77 5.72,14.15 5.72,14.78 6.1,15.16 6.73,15.16 6.86,15.03 USBC1.A6 8.46,15.03 8.5,14.99 8.63,14.99 10.21,16.56 10.21,23.07 9.77,23.5 9.77,24.59 10.21,25.03 10.21,25.54 10.12,25.63 CH340C.5
USBD+1: length 18.1
  Top Layer w0.254: 69.73,8.56 70.23,9.07 70.73,8.57 USBC2.B6 ; 69.73,8.56 USBC2.A6 ; 69.73,8.56 69.73,8.64 69.68,8.68 69.68,17.2 65.67,21.21 65.38,21.21 CH340C#2.5
USBD-: length 18.2
  Top Layer w0.254: USBC1.B7 6.9,15.53 6.77,15.67 6.48,15.67 v1(6.48,16.05) ; CH340C.6 10.71,25.63 10.62,25.54 10.62,16.4 8.8,14.58 8.5,14.58 8.46,14.53 USBC1.A7 6.48,14.53 v1(6.48,14.53)
  Bottom Layer w0.254: v1(6.48,14.53) 6.35,14.53 5.97,14.91 5.97,15.54 v1(6.48,16.05)
USBD-1: length 18.3
  Top Layer w0.254: USBC2.A7 70.23,7.03 69.72,6.53 69.23,7.02 USBC2.B7 69.23,8.64 69.27,8.68 69.27,17.03 65.5,20.8 65.38,20.8 CH340C#2.6
USBDM: length 54.6
  Top Layer w0.254: v1(10.03,59.49) 9.52,60 USBC3.A7 6.86,60 6.73,59.87 5.59,59.87 4.95,60.5 5.59,61.14 6.64,61.14 6.78,61 USBC3.B7 ; U3.27 45.21,43.7 45.64,44.13 45.88,44.13 45.97,44.04 v1(45.97,43.61)
  Bottom Layer w0.254: v1(10.03,59.49) 10.03,60.02 10.12,60.11 10.25,60.11 10.87,59.49 18.35,59.49 25.87,51.97 37.32,51.97 45.18,44.11 45.48,44.11 v1(45.97,43.61)
USBDP: length 53.9
  Top Layer w0.254: v1(6.1,60.5) 6.1,60.5 USBC3.A6 7.55,60.51 7.56,60.52 9.41,60.52 v1(10.03,61.14) ; USBC3.B6 7.48,59.43 6.29,59.43 v1(6.1,59.23) ; U3.28 45.21,44.97 45.64,44.54 45.88,44.54 45.97,44.63 v1(45.97,45.01)
  Bottom Layer w0.254: v1(10.03,61.14) 10.03,60.61 10.12,60.52 10.42,60.52 11.04,59.89 18.52,59.89 26.03,52.37 37.49,52.37 45.35,44.51 45.48,44.51 v1(45.97,45.01) ; v1(6.1,60.5) 5.84,60.5 5.33,59.99 v1(6.1,59.23)
VSIM: length 47.9
  Top Layer w0.254: U3.22 41.82,37.35 41.02,38.15 34.42,38.15 32.51,40.06 32.51,41.71 32.13,42.09 29.84,42.09 28.45,43.48 v1(28.45,53.9)
  Bottom Layer w0.254: CARD1.6 28.99,60.37 CARD1.1 26.45,55.89 v1(28.45,53.9)
WH_RX: length 44.3
  Top Layer w0.254: U3.36 43.69,54.94 42.12,54.94 41.52,54.33 41.52,46.45 41.26,46.19 41.26,44.92 41.52,44.67 41.52,44.16 41.28,43.92 v1(41.28,43.48)
  Bottom Layer w0.254: v1(41.28,43.48) 41.28,42.67 41.52,42.43 41.52,42.3 41.43,42.21 40.26,42.21 38.09,40.04 14.86,40.04 U5.3
WH_TX: length 41.8
  Top Layer w0.254: U3.35 43.88,54.2 43.79,54.29 42.66,54.29 42.42,54.53 42.29,54.53 41.92,54.17 41.92,44.16 42.16,43.92 v1(42.16,43.1)
  Bottom Layer w0.254: U5.4 17.23,38.9 17.97,39.64 38.25,39.64 40.43,41.81 41.59,41.81 41.92,42.14 41.92,42.43 42.16,42.67 v1(42.16,43.1)
WORK: length 5.5
  Top Layer w0.254: R14.2 15.54,45.02 16.76,46.24 U3.14
WRST: length 4.5
  Top Layer w0.254: U3.9 17.18,52.59 16.76,53.01 16.76,54.7 RST#2.2
$1N2451: length 4.6
  Top Layer w0.254: R3.2 53.37,55.68 SW3.1
$1N2460: length 4.8
  Top Layer w0.254: R2.2 14.84,61.54 15.24,61.14 16.7,61.14 RST#2.1
$1N2726: length 3.2
  Bottom Layer w0.508: R4.1 7.07,49.79 7.89,50.61 9.18,50.61 Q1.3
$1N2765: length 4.5
  Bottom Layer w0.508: R5.1 7.11,52 7.11,53.39 7.13,53.39 8.25,54.52 Q2.3
$1N2804: length 2.6
  Bottom Layer w0.508: Q3.3 9.59,47.22 R6.1
$1N2899: length 3.2
  Bottom Layer w0.508: R7.1 7.07,44.72 7.89,43.9 9.19,43.9 Q4.3
$1N2935: length 1.7
  Bottom Layer w0.508: v1(3.4,49.65) 5.06,49.65 R4.2
$1N2943: length 1.7
  Bottom Layer w0.508: v1(3.37,52.01) 5.02,52.01 R5.2
$1N2948: length 1.8
  Bottom Layer w0.508: R7.2 3.61,44.84 v1(3.37,45.09)
$1N2949: length 1.8
  Bottom Layer w0.508: v1(3.37,47.35) 3.51,47.22 R6.2
$1N3568: length 2.7
  Top Layer w0.508: R10.2 10.65,51.61 R12.1
  Bottom Layer w0.508: v1(10.67,51.61) 10.67,52.45 Q2.1
$1N3650: length 6.1
  Top Layer w0.508: v1(12.39,45.02) R8.2
  Bottom Layer w0.508: Q4.1 12.39,43.23 v1(12.39,45.02)
$1N3655: length 3.7
  Top Layer w0.508: v1(10.65,47.23) 12.37,47.23 R13.1
  Bottom Layer w0.508: Q3.1 10.65,45.33 v1(10.65,47.23)
$1N3697: length 1.7
  Top Layer w0.508: R15.1 12.38,49.31 v1(10.65,49.31)
$1N3835: length 5.9
  Top Layer w0.508: LED5.2 5.49,39.8 6.48,39.8 8.18,41.5 R16.2
$1N3918: length 2.4
  Top Layer w0.254: 17.02,66.81 19.08,66.81 R17.2
$1N4097: length 2.7
  Top Layer w0.254: R18.2 52.02,52.54 LED7.2
$1N4826: length 3.2
  Top Layer w0.254: USBC1.B5 4.85,13.03 v1(4.57,12.75)
$1N4873: length 6.4
  Top Layer w0.254: v1(9.02,16.31) 8.74,16.03 USBC1.A5
  Bottom Layer w0.254: R20.1 4.57,15.93 5.33,16.69 8.64,16.69 v1(9.02,16.31)
  vias: v1(4.59,15.93)
$1N6955: length 2
  Bottom Layer w0.254: R24.2 56.87,46.52 v1(54.94,46.52)
$1N7251: length 3
  Top Layer w0.254: USBC2.B5 71.73,7.08 71.5,6.86 v1(71.5,4.98)
$1N7254: length 3
  Top Layer w0.254: USBC2.A5 68.73,7.08 68.44,6.79 v1(68.44,4.98)
$1N7760: length 19.5
  Bottom Layer w0.178: 65.53,25.45 66,24.98 66.23,24.98 66.48,24.72 66.48,18.39 67.16,17.71 67.16,17.49 67.44,17.21 v1(67.44,16.56) 67.44,16.17 67.16,15.89 67.16,14.94 67.56,14.53 68.24,14.53 70.04,16.33 72.4,16.33 72.66,16.07 72.66,15.85 R27.2
$1N7771: length 19.3
  Bottom Layer w0.178: R28.1 72.33,15.85 72.33,15.94 72.27,16 70.18,16 68.38,14.2 67.43,14.2 66.83,14.8 66.83,15.89 66.55,16.17 v1(66.55,16.81) 66.55,17.21 66.83,17.49 66.83,17.58 66.15,18.25 66.15,19.36 65.9,19.61 65.9,20.88 66.15,21.14 66.15,22.41 65.9,22.66 65.9,23.93 66.15,24.18 66.15,24.59 66.09,24.65 66,24.65 65.53,24.18
$2N1856: length 2.7
  Top Layer w0.254: USBC3.B5 7.51,58.55 v1(4.91,58.55)
$2N1859: length 2.8
  Top Layer w0.254: v1(4.9,61.77) 5.18,61.5 USBC3.A5
$2N2137: length 4.8
  Top Layer w0.508: 14.96,19.02 14.54,18.6 R44.2 ; 14.96,19.02 R43.1 ; 14.96,19.02 AMS1117-ADJ.1
$2N3608:
  vias: v3(56.07,32.31)
$2N3829:
  vias: v1(75.54,51.41)

## Copper pours and planes (outline as drawn; the poured copper is in the pictures)
1V8 on Top Layer: 28.19,17.45 27.69,17.96 27.69,23.04 27.81,23.16 27.81,26.09 27.18,26.72 27.18,30.4 27.69,30.91 29.46,30.91 29.84,30.53 29.84,24.56 29.46,24.18 29.46,17.7 29.21,17.45
3V3 on Top Layer: 36.23,25.01 34.29,23.07 34.29,21.64 36.83,19.1 38.23,19.1 40.26,21.13 36.32,25.07 36.19,25.07 36.23,25.04
3V3 on Top Layer: 22.88,4.62 22.88,4.9 23.5,5.51 28.07,5.51 28.83,6.27 28.83,10.97 29.59,11.73 30.98,11.73 31.75,10.96 31.75,6.91 32.26,6.4 32.26,2.34 31.75,1.83 29.97,1.83 28.19,3.61 23.37,3.61 22.86,4.11 22.86,4.65
3V3 on Inner2: 36.29,24.11 37.37,24.11 37.37,23.03 36.29,23.03
3V3 on Inner2: 37.27,21.49 38.35,21.49 38.35,20.41 37.27,20.41
3V3 on Inner2: 0.26,71.3 85.85,71.3 85.85,0.26 0.26,0.26
3V3 on Inner2: 38.09,21.49 39.17,21.49 39.17,20.41 38.09,20.41
3V3 on Inner2: 35.47,23.29 36.55,23.29 36.55,22.21 35.47,22.21
3V3 on Inner2: 38.09,22.31 39.17,22.31 39.17,21.23 38.09,21.23
3V3 on Inner2: 35.47,24.1 36.55,24.1 36.55,23.03 35.47,23.03
3V3 on Inner2: 37.27,22.31 38.35,22.31 38.35,21.23 37.27,21.23
3V3 on Inner2: 36.29,23.29 37.37,23.29 37.37,22.21 36.29,22.21
3V8 on Top Layer: 15.96,15.55 15.96,22.57 15.24,23.29 15.24,27.23 15.11,27.36 15.11,28.75 15.88,29.51 17.78,29.51 18.38,28.91 18.38,25.22 18.29,22.72 18.29,15.54 18.16,15.42 16.1,15.42
5V0 on Top Layer: 18.73,20.31 18.73,15.35 18.67,15.29 14.48,15.29 13.97,14.78 13.97,13.13 14.48,12.62 18.8,12.62 20.45,14.27 24.89,14.27 26.29,15.67 30.88,15.67 32.38,17.38 32.38,19.79 31.78,20.39 30.5,20.39 29.84,19.74 29.84,17.45 29.59,17.2 20.44,17.2 20.44,20.33 18.76,20.33
GND on Top Layer: 0,71.55 86.11,71.55 86.11,0 0,0
GND on Bottom Layer: 0,71.55 86.11,71.55 86.11,0 0,0
GND on Inner1: 40.86,25.08 41.94,25.08 41.94,24 40.86,24
GND on Inner1: 39.88,26.88 40.96,26.88 40.96,25.8 39.88,25.8
GND on Inner1: 0.26,71.3 85.85,71.3 85.85,0.26 0.26,0.26
GND on Inner1: 41.68,25.9 42.76,25.9 42.76,24.82 41.68,24.82
GND on Inner1: 39.88,27.7 40.96,27.7 40.96,26.62 39.88,26.62
GND on Inner1: 41.68,25.08 42.76,25.08 42.76,24 41.68,24
GND on Inner1: 40.86,25.9 41.94,25.9 41.94,24.82 40.86,24.82
GND on Inner1: 39.07,26.88 40.14,26.88 40.14,25.8 39.07,25.8
GND on Inner1: 39.07,27.7 40.14,27.7 40.14,26.62 39.07,26.62
ADC_IN4 on Top Layer: 45.21,13.13 42.29,16.05 42.29,17.13 43.52,18.35 43.52,19.92 44.28,20.69 44.28,20.79 46.35,18.72 46.35,18.59 45.47,17.7 44.7,17.7 44.58,17.58 44.58,16.49 45.28,16.49 47.12,14.66 47.12,14.15 46.1,13.13

Small or netless copper shapes (teardrops, artwork), in the pictures only: 1 on Top Layer, 119 on Inner1, 36 on Inner2

## Text on the board
Bottom Silkscreen Layer: 5.1kΩ | 4.7kΩ | 10uF | 1uF | 10kΩ | 100nF | 0Ω | 1.2kΩ
Top Silkscreen Layer: BOOT1 | 10kΩ | WH_RX | UART1_TX | UART1_RX | CH340TX | 200Ω | 1kΩ | 3V8Power | 100Ω | WH_TX | 10uF | 100nF | CH340RX | 100uF | SDA | SCL | 3V3 | 1 | 0 | 1V8Power | RELOAD | GN100WK | PC13 | SRST | GND | SWCLK | SWIO | GPIO15 | 1uF | GPIO14 | FORCE_ON | RX1 | TX1 | B9 | B8 | B7 | B6 | B5 | B4 | B3 | A15 | A12 | UART2R/T | CH340T/R | GN100R/T | UART2T/X | A11 | A10 | A9 | A8 | B15 | B14 | B13 | B12 | B11 | B10 | B1 | B0 | A7 | A6 | A5 | A4 | A3 | A2 | A1 | A0 | BOOT0 | LA | LB | DA | WK | 3V3powre | 2kΩ | 5V | 32电源指示 | Iot-Whgm5开发板 Ver1.0
